# EasyEDA Pro project hardware.eprj, schematic Schematic1
Create Date: 2022-11-13; Page Name: P1; Project Name: SCH_tc264_2022-07-02; Schematic Name: Schematic1; Update Date: 2022-11-13; Company: 嘉立创EDA; Page Size: A4; Version: V1.0
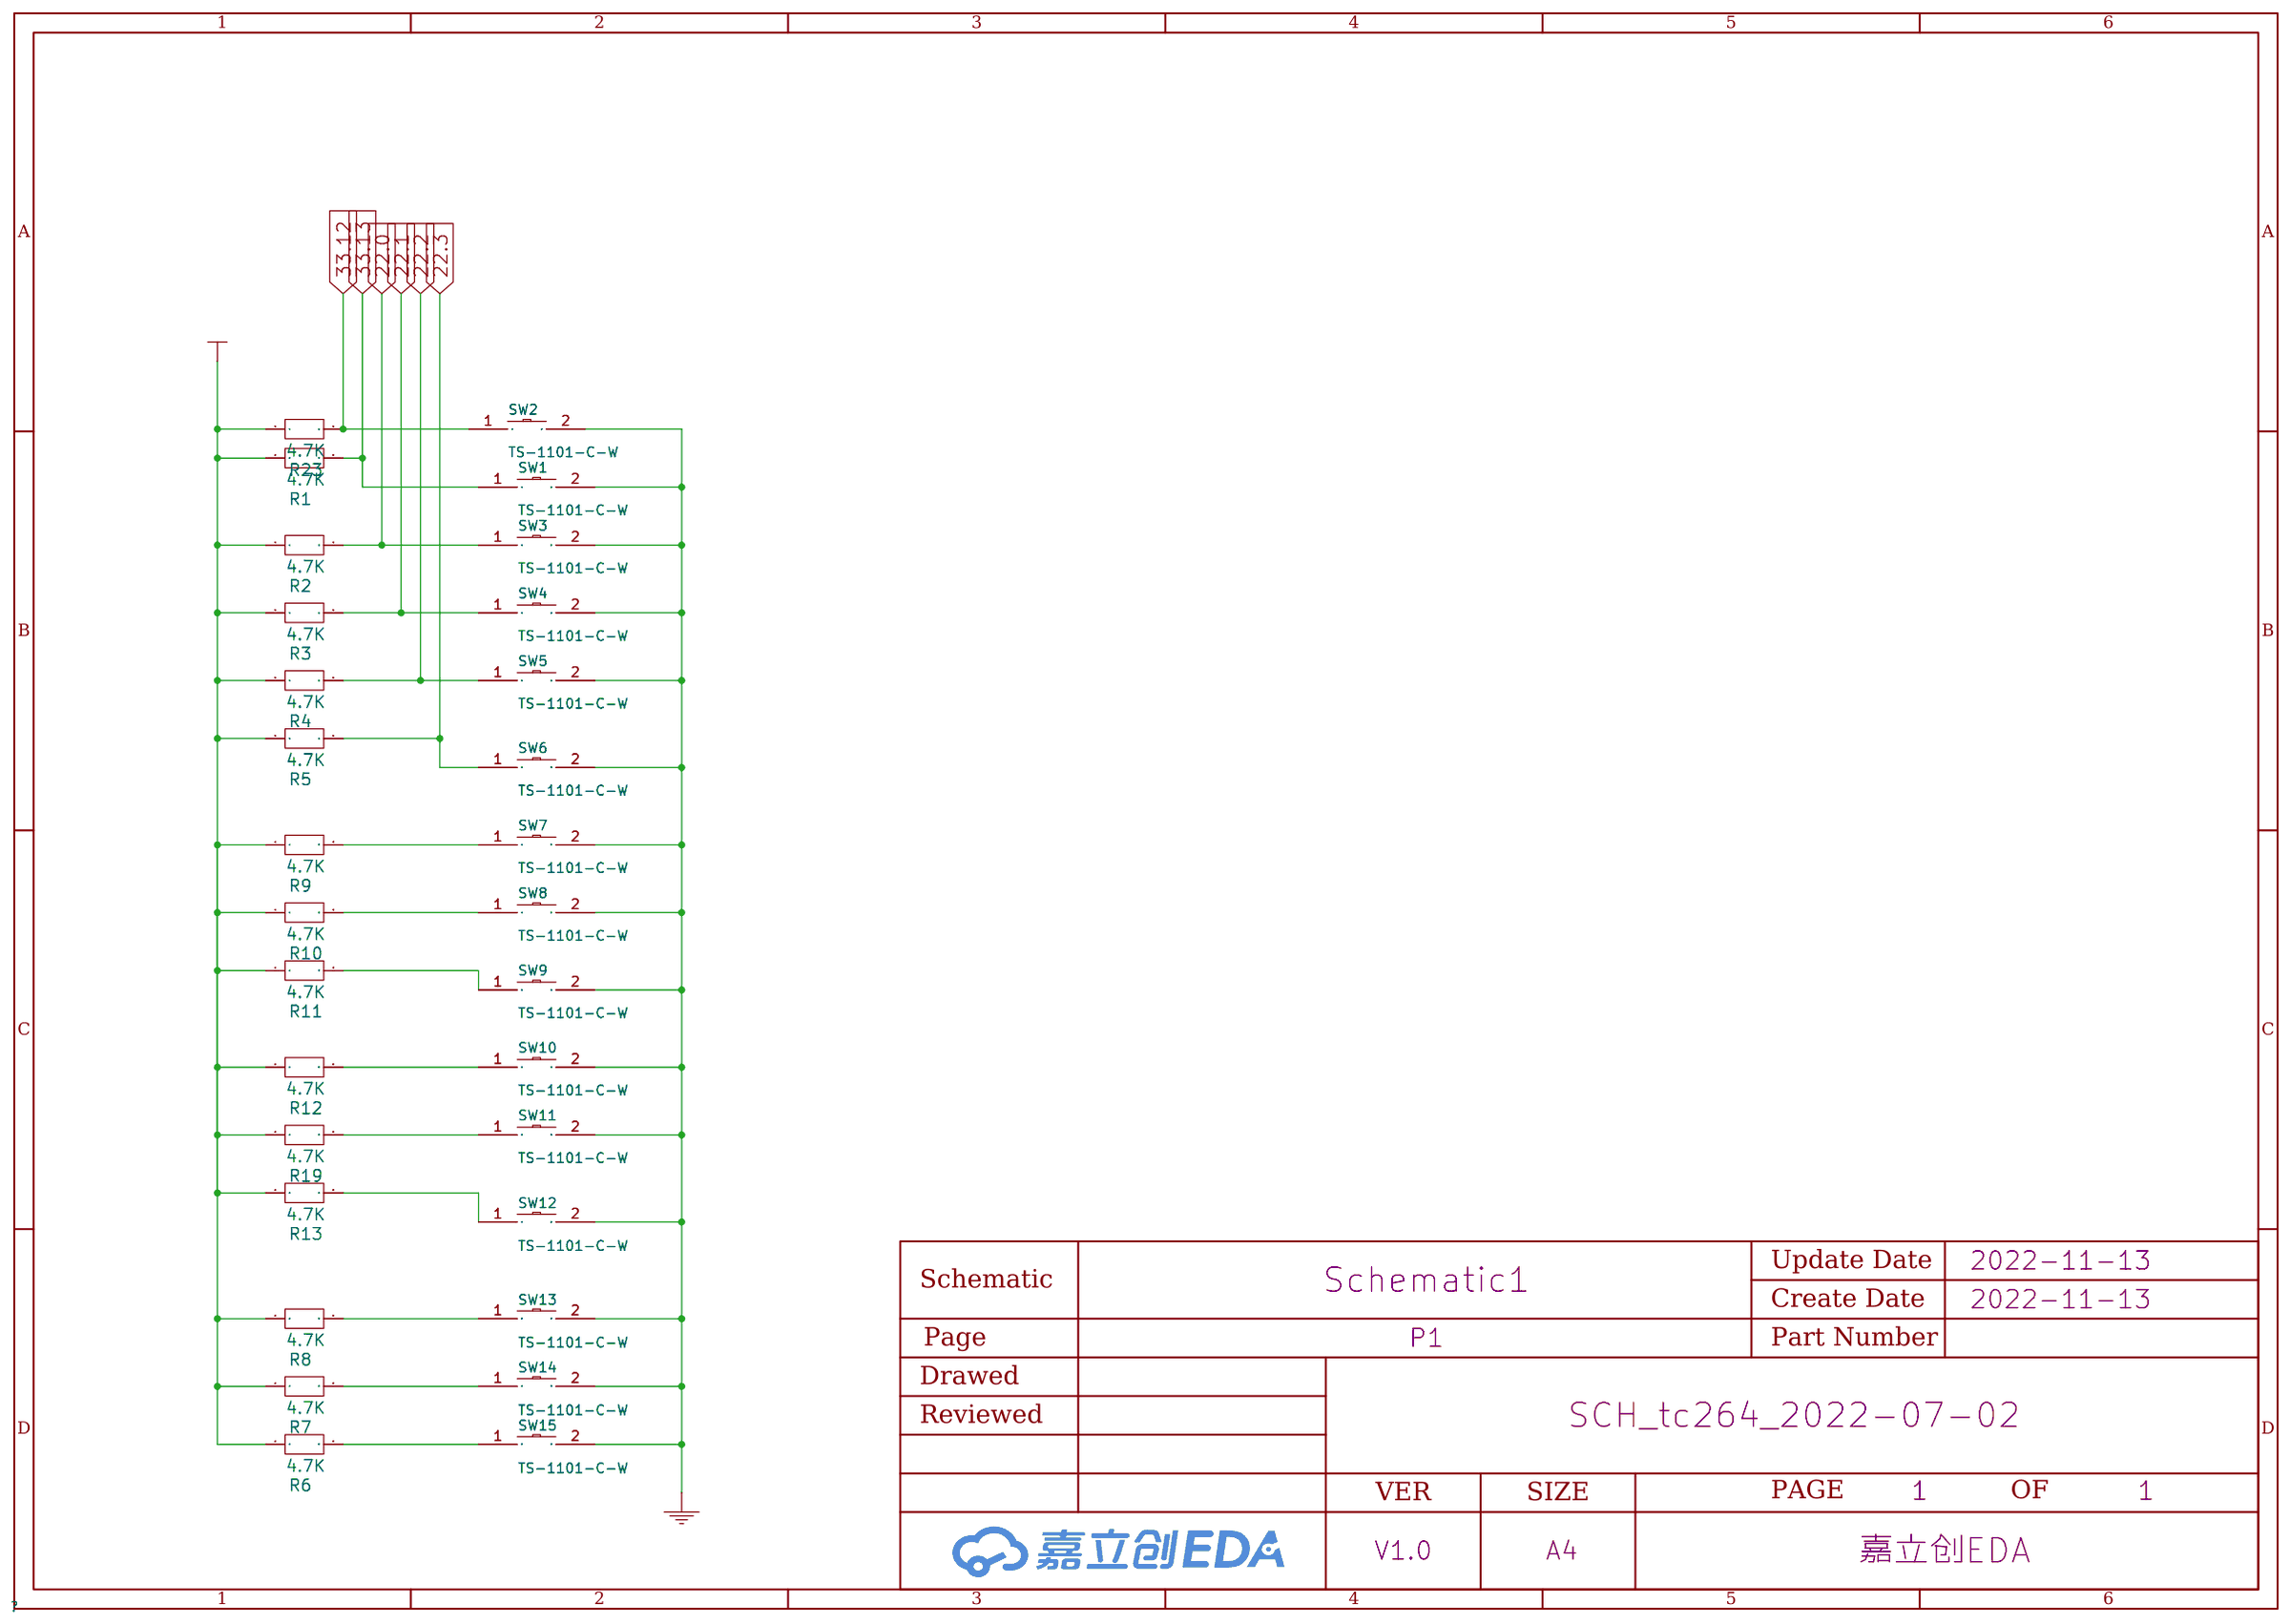
[diagram p1: schematic sheet]

## Parts
R1  4.7K  [R0805]
R2  4.7K  [R0805]
R3  4.7K  [R0805]
R4  4.7K  [R0805]
R5  4.7K  [R0805]
R6  4.7K  [R0805]
R7  4.7K  [R0805]
R8  4.7K  [R0805]
R9  4.7K  [R0805]
R10  4.7K  [R0805]
R11  4.7K  [R0805]
R12  4.7K  [R0805]
R13  4.7K  [R0805]
R19  4.7K  [R0805]
R23  4.7K  [R0805]
SW1  TS-1101-C-W  [SW-SMD_L6.0-W3.3-LS8.0]
SW2  TS-1101-C-W  [SW-SMD_L6.0-W3.3-LS8.0]
SW3  TS-1101-C-W  [SW-SMD_L6.0-W3.3-LS8.0]
SW4  TS-1101-C-W  [SW-SMD_L6.0-W3.3-LS8.0]
SW5  TS-1101-C-W  [SW-SMD_L6.0-W3.3-LS8.0]
SW6  TS-1101-C-W  [SW-SMD_L6.0-W3.3-LS8.0]
SW7  TS-1101-C-W  [SW-SMD_L6.0-W3.3-LS8.0]
SW8  TS-1101-C-W  [SW-SMD_L6.0-W3.3-LS8.0]
SW9  TS-1101-C-W  [SW-SMD_L6.0-W3.3-LS8.0]
SW10  TS-1101-C-W  [SW-SMD_L6.0-W3.3-LS8.0]
SW11  TS-1101-C-W  [SW-SMD_L6.0-W3.3-LS8.0]
SW12  TS-1101-C-W  [SW-SMD_L6.0-W3.3-LS8.0]
SW13  TS-1101-C-W  [SW-SMD_L6.0-W3.3-LS8.0]
SW14  TS-1101-C-W  [SW-SMD_L6.0-W3.3-LS8.0]
SW15  TS-1101-C-W  [SW-SMD_L6.0-W3.3-LS8.0]

## Library data of the parts
R1-R13 R19 R23 = 4.7K: link: https://item.szlcsc.com/142685.html; 3DModel: R0805_L2.0-W1.3-H0.6
SW1-SW15 = TS-1101-C-W: 触点电流:50mA;额定电压(DC):12V;绝缘电阻:100mΩ;电路结构:单刀单掷;安装方式:立贴;按钮形状:矩形按钮;按钮/盖帽颜色:白色;带灯:无;作用力:260gf;机械寿命:50000;工作温度:-30~+85;开关长度:6mm;开关宽度:3.6mm;开关高度:2.5mm;带支架:否;; LCSC Part Name: TS-1101-C-W 一型3*6*2.5有白ZD b拉伸白色按键 卷装; Supplier Part: C318938; Manufacturer: XKB Connectivity(中国星坤); Supplier Footprint: SMD; JLCPCB Part Class: Extended Part; Datasheet: https://atta.szlcsc.com/upload/public/pdf/source/20200227/C318938_C2E53B1EEDE37D980A33616AC086DE53.pdf; Supplier: LCSC; Contact Current: 50mA; Voltage Rating (DC): 12V; Insulation Resistance: 100mΩ; Circuit: 单刀单掷; Mounting Style: 立贴; Actuator Style: 矩形按钮; Actuator/Cap Color: 白色; With Lamp: 无; Operating Force: 260gf; Mechanical Life: 50000; Operating Temperature: -30~+85; Switch Length: 6mm; Switch Width: 3.6mm; Switch Height: 2.5mm; Strike Gundam: 否

## Nets
GND5V: SW1.2 SW2.2 SW3.2 SW4.2 SW5.2 SW6.2 SW7.2 SW8.2 SW9.2 SW10.2 SW11.2 SW12.2 SW13.2 SW14.2 SW15.2
VCC3V3: R1.1 R2.1 R3.1 R4.1 R5.1 R6.1 R7.1 R8.1 R9.1 R10.1 R11.1 R12.1 R13.1 R19.1 R23.1
22.0: R2.2 SW3.1
22.1: R3.2 R8.2 R9.2 R12.2 SW4.1 SW7.1 SW10.1 SW13.1
22.2: R4.2 R7.2 R10.2 R19.2 SW5.1 SW8.1 SW11.1 SW14.1
22.3: R5.2 R6.2 R11.2 R13.2 SW6.1 SW9.1 SW12.1 SW15.1
33.12: R23.2 SW2.1
33.13: R1.2 SW1.1
